# EasyEDA Pro project Archive.eprj, board GPR1.1
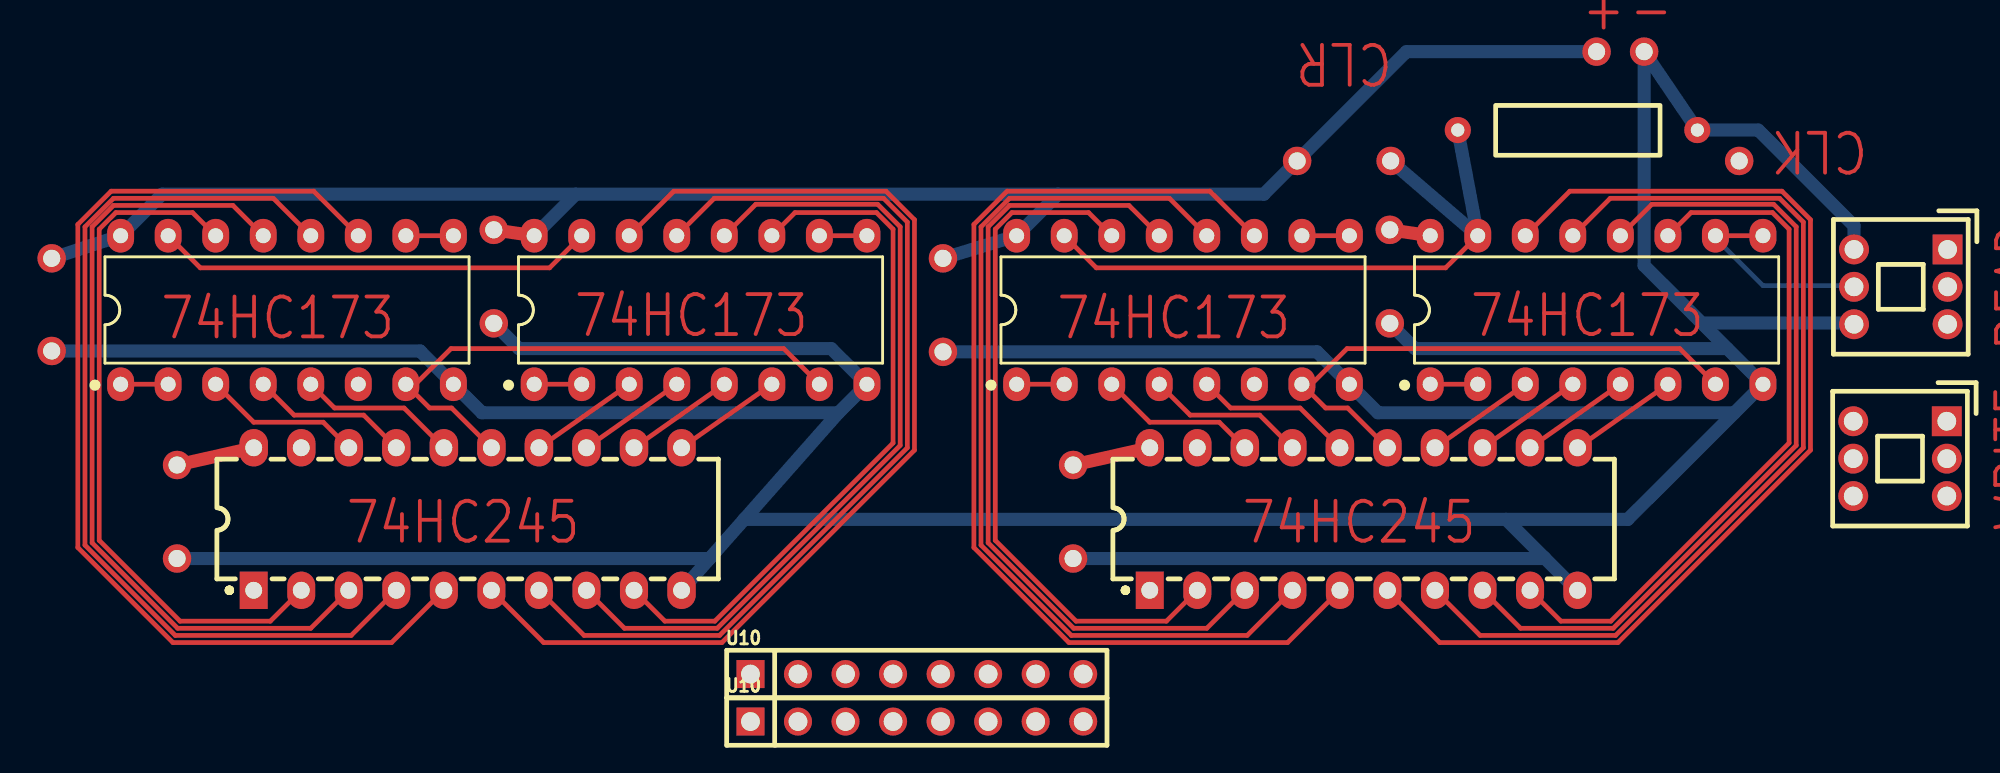
[diagram p8: board, top side]
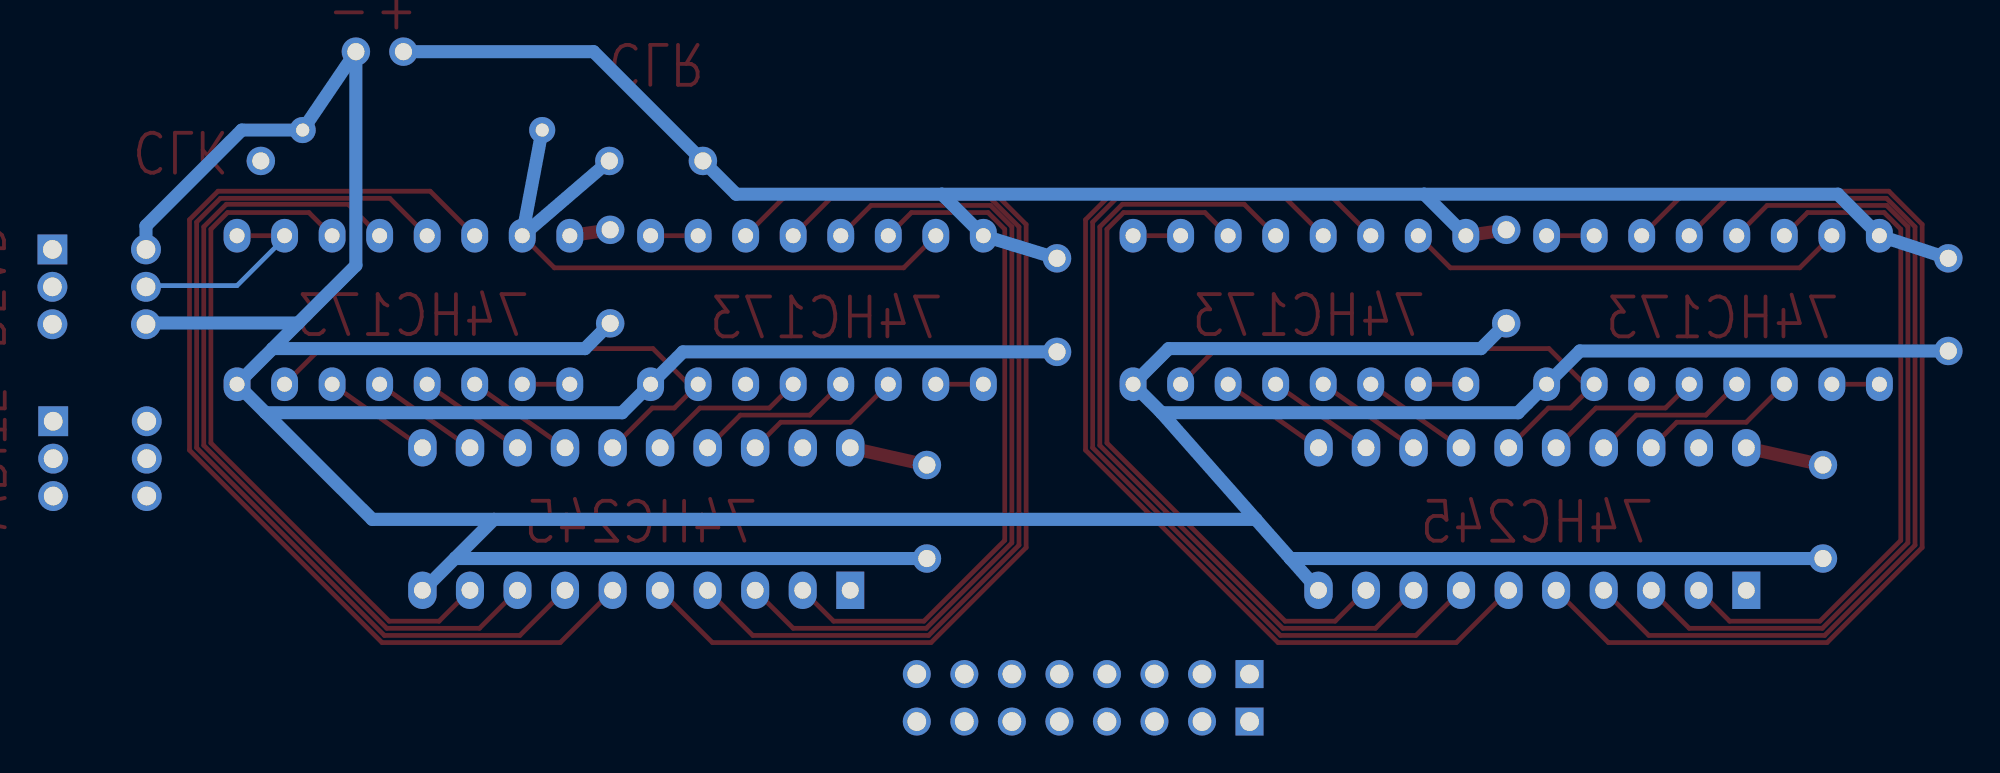
[diagram p9: board, bottom side, seen from below]

No outline. copper layers: Top Layer, Inner1, Inner2, Bottom Layer. Coordinates in mm from the lowest, leftmost part position.
Stack: Top Layer 0.035mm / Dielectric1 1.51mm FR4 er 4.5 / Inner1 0.035mm / Dielectric2 0.48mm PP er 4.5 / Inner2 0.035mm / Dielectric3 0.48mm PP er 4.5 / Bottom Layer 0.035mm

## Design rules (mm)
template: JLCPCB Capability(Two Layers Board)
spacing copperThickness1oz (default): track to track 0.102, other pairs 0.152 to 0.3
spacing copperThickness2oz: track to track 0.203, other pairs 0.152 to 0.3
track width copperThickness1oz (default): min 0.127, default 0.254, max 2.54
track width copperThickness2oz: min 0.203, default 0.254, max 2.54
differential pair differentialPair (default): width min 0.127, default 0.254, max 2.54; gap min 0.152, default 0.152
via viaSize (default): diameter min 0.5, default 0.61, max 10; hole min 0.3, default 0.305, max 6.3

## Placement (name value [footprint] x y rotation side)
NOREF  -  [Pad_e412]  71.55 29.97 180 top
NOREF#2  -  [Pad_e417]  90.17 29.97 180 top
NOREF#3  -  [Pad_e409]  66.55 29.97 180 top
NOREF#4  -  [Pad_e405]  54.58 13.72 0 top
NOREF#5  -  [Pad_e402]  23.62 26.29 0 top
NOREF#6  -  [Pad_e413]  82.55 35.81 0 top
NOREF#7  -  [Pad_e403]  47.62 24.77 0 top
NOREF#8  -  [Pad_e398]  0 24.77 0 top
NOREF#9  -  [Pad_e414]  85.09 35.81 0 top
NOREF#10  -  [Pad_e404]  47.62 19.77 0 top
NOREF#11  -  [Pad_e401]  23.62 21.29 0 top
NOREF#12  -  [Pad_e399]  6.7 8.72 0 top
NOREF#13  -  [Pad_e397]  0 19.81 0 top
NOREF#14  -  [Pad_e406]  54.58 8.72 0 top
NOREF#15  -  [Pad_e410]  71.5 21.29 0 top
NOREF#16  -  [Pad_e411]  71.5 26.29 0 top
NOREF#17  -  [Pad_e400]  6.7 13.72 0 top
SW2  -  [SW-TH_6P-L7.0-W7.0-P2.00]  98.76 14.06 0 top
SW2#2  -  [SW-TH_6P-L7.0-W7.0-P2.00]  98.81 23.24 0 top
U1  -  [PDIP-16_L19.3-W6.4-P2.54-LS7.94-BL]  12.57 22 0 top
U1#2  -  [PDIP-16_L19.3-W6.4-P2.54-LS7.94-BL]  60.45 22 0 top
U4  -  [PDIP-16_L19.3-W6.4-P2.54-LS7.94-BL]  34.67 22 0 top
U4#2  -  [PDIP-16_L19.3-W6.4-P2.54-LS7.94-BL]  82.55 22 0 top
U5  -  [DIP-20_L26.8-W6.4-P2.54-LS7.6-BL]  22.22 10.83 0 top
U5#2  -  [DIP-20_L26.8-W6.4-P2.54-LS7.6-BL]  70.1 10.83 0 top
U9  AXIAL-0.4  [RES-TH_BD2.7-L8.8-P12.80-D0.5]  81.53 31.62 180 top
U10  -  [HDR-TH_8P-P2.54-V-M-4]  46.23 0 0 top
U10#2  -  [HDR-TH_8P-P2.54-V-M-4]  46.23 2.54 0 top

## Footprints (pads in the part's own frame, mm; a bottom-side part is the same pattern mirrored in y, then rotated)
DIP-20_L26.8-W6.4-P2.54-LS7.6-BL
  rect 1.5x2 hole 0.9: 1(-11.43,-3.81)
  oval 1.5x2 hole 0.9: 2(-8.89,-3.81) 3(-6.35,-3.81) 4(-3.81,-3.81) 5(-1.27,-3.81) 6(1.27,-3.81) 7(3.81,-3.81) 8(6.35,-3.81) 9(8.89,-3.81)
  oval 1.524x2 hole 0.9: 10(11.43,-3.81) 11(11.43,3.81) 12(8.89,3.81) 13(6.35,3.81) 14(3.81,3.81) 15(1.27,3.81) 16(-1.27,3.81) 17(-3.81,3.81) 18(-6.35,3.81) 19(-8.89,3.81) 20(-11.43,3.81)
HDR-TH_8P-P2.54-V-M-4
  rect 1.5x1.5 hole 1: 1(-8.89,0)
  round 1.5 hole 1: 2(-6.35,0) 3(-3.81,0) 4(-1.27,0) 5(1.27,0) 6(3.81,0) 7(6.35,0) 8(8.89,0)
Pad_e397
  round 1.524 hole 0.914: 2(0,0)
Pad_e398
  round 1.524 hole 0.914: 1(0,0)
Pad_e399
  round 1.524 hole 0.914: 2(0,0)
Pad_e400
  round 1.524 hole 0.914: 1(0,0)
Pad_e401
  round 1.524 hole 0.914: 2(0,0)
Pad_e402
  round 1.524 hole 0.914: 1(0,0)
Pad_e403
  round 1.524 hole 0.914: 1(0,0)
Pad_e404
  round 1.524 hole 0.914: 2(0,0)
Pad_e405
  round 1.524 hole 0.914: 1(0,0)
Pad_e406
  round 1.524 hole 0.914: 2(0,0)
Pad_e409
  round 1.524 hole 0.914: 1(0,0)
Pad_e410
  round 1.524 hole 0.914: 2(0,0)
Pad_e411
  round 1.524 hole 0.914: 1(0,0)
Pad_e412
  round 1.524 hole 0.914: 2(0,0)
Pad_e413
  round 1.524 hole 0.914: 2(0,0)
Pad_e414
  round 1.524 hole 0.914: 1(0,0)
Pad_e417
  round 1.524 hole 0.914: 1(0,0)
PDIP-16_L19.3-W6.4-P2.54-LS7.94-BL
  oval 1.44x1.8 hole 0.8: 1(-8.89,-3.97) 2(-6.35,-3.97) 3(-3.81,-3.97) 4(-1.27,-3.97) 5(1.27,-3.97) 6(3.81,-3.97) 7(6.35,-3.97) 8(8.89,-3.97) 9(8.89,3.97) 10(6.35,3.97) 11(3.81,3.97) 12(1.27,3.97) 13(-1.27,3.97) 14(-3.81,3.97) 15(-6.35,3.97) 16(-8.89,3.97)
RES-TH_BD2.7-L8.8-P12.80-D0.5
  round 1.4 hole 0.7: 1(-6.4,0) 2(6.4,0)
SW-TH_6P-L7.0-W7.0-P2.00
  rect 1.6x1.6 hole 1: 1(2.499,2)
  round 1.6 hole 1: 2(2.5,0) 3(2.5,-2) 4(-2.5,2) 5(-2.5,0) 6(-2.5,-2)

## Nets

Pads without a net: NOREF 2; NOREF#2 1; NOREF#3 1; NOREF#4 1; NOREF#5 1; NOREF#6 2; NOREF#7 1; NOREF#8 1; NOREF#9 1; NOREF#10 2; NOREF#11 2; NOREF#12 2; NOREF#13 2; NOREF#14 2; NOREF#15 2; NOREF#16 1; NOREF#17 1; SW2 1 2 3 4 5 6; SW2#2 1 2 3 4 5 6; U1 1 2 3 4 5 6 7 8 9 10 11 12 13 14 15 16; U1#2 1 2 3 4 5 6 7 8 9 10 11 12 13 14 15 16; U4 1 2 3 4 5 6 7 8 9 10 11 12 13 14 15 16; U4#2 1 2 3 4 5 6 7 8 9 10 11 12 13 14 15 16; U5 1 2 3 4 5 6 7 8 9 10 11 12 13 14 15 16 17 18 19 20; U5#2 1 2 3 4 5 6 7 8 9 10 11 12 13 14 15 16 17 18 19 20; U9 1 2; U10 1 2 3 4 5 6 7 8; U10#2 1 2 3 4 5 6 7 8

## Routing (per net, layer and track width the routed paths; a pad name or vN(x,y) marks a point on that pad's centre or on a via; arc(x,y) is an arc through that point)
(no net): length 1907.7
  Top Layer w0.254: U5.3 13.84,4.99 6.73,4.99 2.16,9.56 2.16,26.45 3.3,27.59 9.69,27.59 U1.13 ; U4.10 U4.9 ; U5.17 16.67,16.38 12.95,16.38 U1.4 ; U4#2.14 81.12,28.35 92.46,28.35 93.98,26.83 93.98,14.51 83.69,4.22 74.17,4.22 U5#2.6 ; U4#2.3 U5#2.14 ; U5.5 18.16,4.22 6.48,4.22 1.4,9.3 1.4,26.58 3.18,28.35 14,28.35 U1.11 ; U5.4 16,4.61 6.6,4.61 1.78,9.43 1.78,26.45 3.3,27.97 11.84,27.97 U1.12 ; U5#2.8 78.49,4.99 83.44,4.99 93.22,14.77 93.22,26.45 92.01,27.66 85.5,27.66 83.82,25.97 ; U4#2.13 83.28,27.97 92.33,27.97 93.6,26.7 93.6,14.64 83.57,4.61 76.33,4.61 U5#2.7 ; U4.13 35.4,27.97 44.45,27.97 45.72,26.7 45.72,14.64 35.69,4.61 28.45,4.61 U5.7 ; U5#2.5 66.04,4.22 54.36,4.22 49.28,9.3 49.28,26.58 51.05,28.35 61.88,28.35 U1#2.11 ; U1.3 10.8,16 14.51,16 U5.18 ; U5.15 21.37,16.76 20.19,16.76 U1.7 19.43,18.03 21.34,19.94 39.12,19.94 U4.7 ; U4.1 U4.2 ; U1#2.2 51.56,18.03 ; U1#2.14 55.41,27.21 51.31,27.21 50.42,26.32 50.42,9.69 54.74,5.37 59.56,5.37 U5#2.2 ; 59.18,18.03 60.83,16.38 64.55,16.38 U5#2.17 ; U1.14 7.53,27.21 3.43,27.21 2.54,26.32 2.54,9.69 6.86,5.37 11.68,5.37 U5.2 ; U4.15 26.6,24.26 7.94,24.26 U1.15 ; U4#2.4 U5#2.13 ; U4.6 U5.11 ; U4.3 U5.14 ; 59.18,25.97 57.56,27.59 51.18,27.59 50.04,26.45 50.04,9.56 54.61,4.99 61.72,4.99 U5#2.3 ; U4.14 33.24,28.35 44.58,28.35 46.1,26.83 46.1,14.51 35.81,4.22 26.29,4.22 U5.6 ; U4#2.15 74.48,24.26 55.82,24.26 U1#2.15 ; U4#2.7 87,19.94 69.22,19.94 67.31,18.03 U1#2.7 68.07,16.76 69.25,16.76 U5#2.15 ; U4#2.11 87.6,27.21 91.95,27.21 92.84,26.32 92.84,14.89 83.31,5.37 80.65,5.37 U5#2.9 ; U1.2 U1.1 ; U1#2.3 58.67,16 62.39,16 U5#2.18 ; 83.82,18.03 U5#2.12 ; U4#2.6 U5#2.11 ; U5.16 18.83,16.76 15.11,16.76 U1.5 ; U4.12 37.62,27.66 44.13,27.66 45.34,26.45 45.34,14.77 35.56,4.99 30.61,4.99 U5.8 ; U1#2.5 62.99,16.76 66.71,16.76 U5#2.16 ; U4.11 39.72,27.21 44.07,27.21 44.96,26.32 44.96,14.89 35.43,5.37 32.77,5.37 U5.9 ; U1.10 U1.9 ; U4#2.10 U4#2.9 ; U4.5 U5.12 ; U1#2.10 U1#2.9 ; U4.4 U5.13 ; U1#2.12 59.72,27.97 51.18,27.97 49.66,26.45 49.66,9.43 54.48,4.61 63.88,4.61 U5#2.4 ; U4#2.1 U4#2.2
  Top Layer w0.7: NOREF#5.1 U4.16 ; NOREF#17.1 U5.20 ; NOREF#16.1 U4#2.16 ; NOREF#4.1 U5#2.20
  Inner1 w0.254: U10.7 53.59,1.02 70.58,1.02 76.45,6.89 ; 15.88,6.89 21.5,1.27 38.61,1.27 U10.2 ; 73.91,6.89 68.42,1.4 51.44,1.4 U10.6 ; 13.34,6.89 20.23,0 U10.1 ; 78.99,6.89 72.1,0 U10.8 ; NOREF#2.1 90.17,19.3 U4#2.7 ; U4.7 43.94,20.95 63.88,20.95 U1#2.7 ; U4.15 31.31,22.99 51.12,22.99 U1#2.15 ; U5.5 22.89,5.08 41.4,5.08 43.56,2.92 43.56,1.52 44.96,0.13 ; U10.5 48.77,1.27 48.77,2.92 49.4,3.56 68.04,3.56 71.37,6.89 ; SW2.5 95.29,13.08 62.77,13.08 U5#2.19 59.6,16.26 14.95,16.26 U5.19 ; 42.42,0.13 41.15,1.4 41.15,2.79 39.24,4.7 20.73,4.7 U5.4
  Inner2 w0.254: 68.83,6.89 65.88,3.94 56.52,3.94 U10#2.8 ; U10#2.5 50.04,5.08 59.4,5.08 61.21,6.89 ; U10#2.4 42.42,5.08 32.93,5.08 31.12,6.89 ; U10#2.3 40.26,4.7 30.77,4.7 28.58,6.89 ; 23.5,6.89 26.45,3.94 35.94,3.94 U10#2.1 ; 63.75,6.89 61.56,4.7 52.2,4.7 U10#2.6 ; U10#2.2 38.1,4.32 28.61,4.32 26.03,6.89 ; 66.29,6.89 63.72,4.32 54.36,4.32 U10#2.7
  Bottom Layer w0.254: SW2#2.5 96.24,23.31 91.44,23.31 88.9,25.85
  Bottom Layer w0.7: 77.71,10.81 84.22,10.81 89.92,16.51 ; 77.71,10.81 37,10.81 ; 77.71,10.81 79.77,8.75 ; 89.92,16.51 U4#2.8 89.53,19.94 ; 89.92,16.51 70.87,16.51 U1#2.8 67.61,19.77 NOREF#10.2 ; U5.10 35.15,8.71 ; 35.15,8.71 37,10.81 ; 35.15,8.71 35.15,8.72 NOREF#12.2 ; 79.77,8.75 79.73,8.72 NOREF#14.2 ; 79.77,8.75 81.5,7.02 U5#2.10 ; NOREF#8.1 U1.16 5.9,28.19 28,28.19 ; 89.53,19.94 88.17,21.31 ; 89.53,19.94 72.85,19.94 NOREF#15.2 ; 88.17,21.31 85.09,24.38 NOREF#9.1 U9.1 91.19,31.62 96.31,26.5 SW2#2.4 ; 88.17,21.31 96.24,21.31 SW2#2.6 ; 53.78,28.19 64.77,28.19 NOREF#3.1 72.39,35.81 NOREF#6.2 ; 53.78,28.19 51.56,25.97 NOREF#7.1 ; 53.78,28.19 28,28.19 ; 28,28.19 U4.16 ; NOREF.2 U4#2.15 75.13,31.62 ; 37,10.81 42.04,16.51 ; 42.04,16.51 22.99,16.51 U1.8 19.69,19.81 0.3,19.81 0.25,19.77 ; 42.04,16.51 U4.8 41.66,19.94 24.97,19.94 NOREF#11.2

## Text on the board
Top Layer: 74HC173 | 74HC245 | + | - | WRITE | CLR | READ | CLK
